# EasyEDA Pro project RCKid3.eprj, schematic RCKid (continued)
## Sheets (continued)
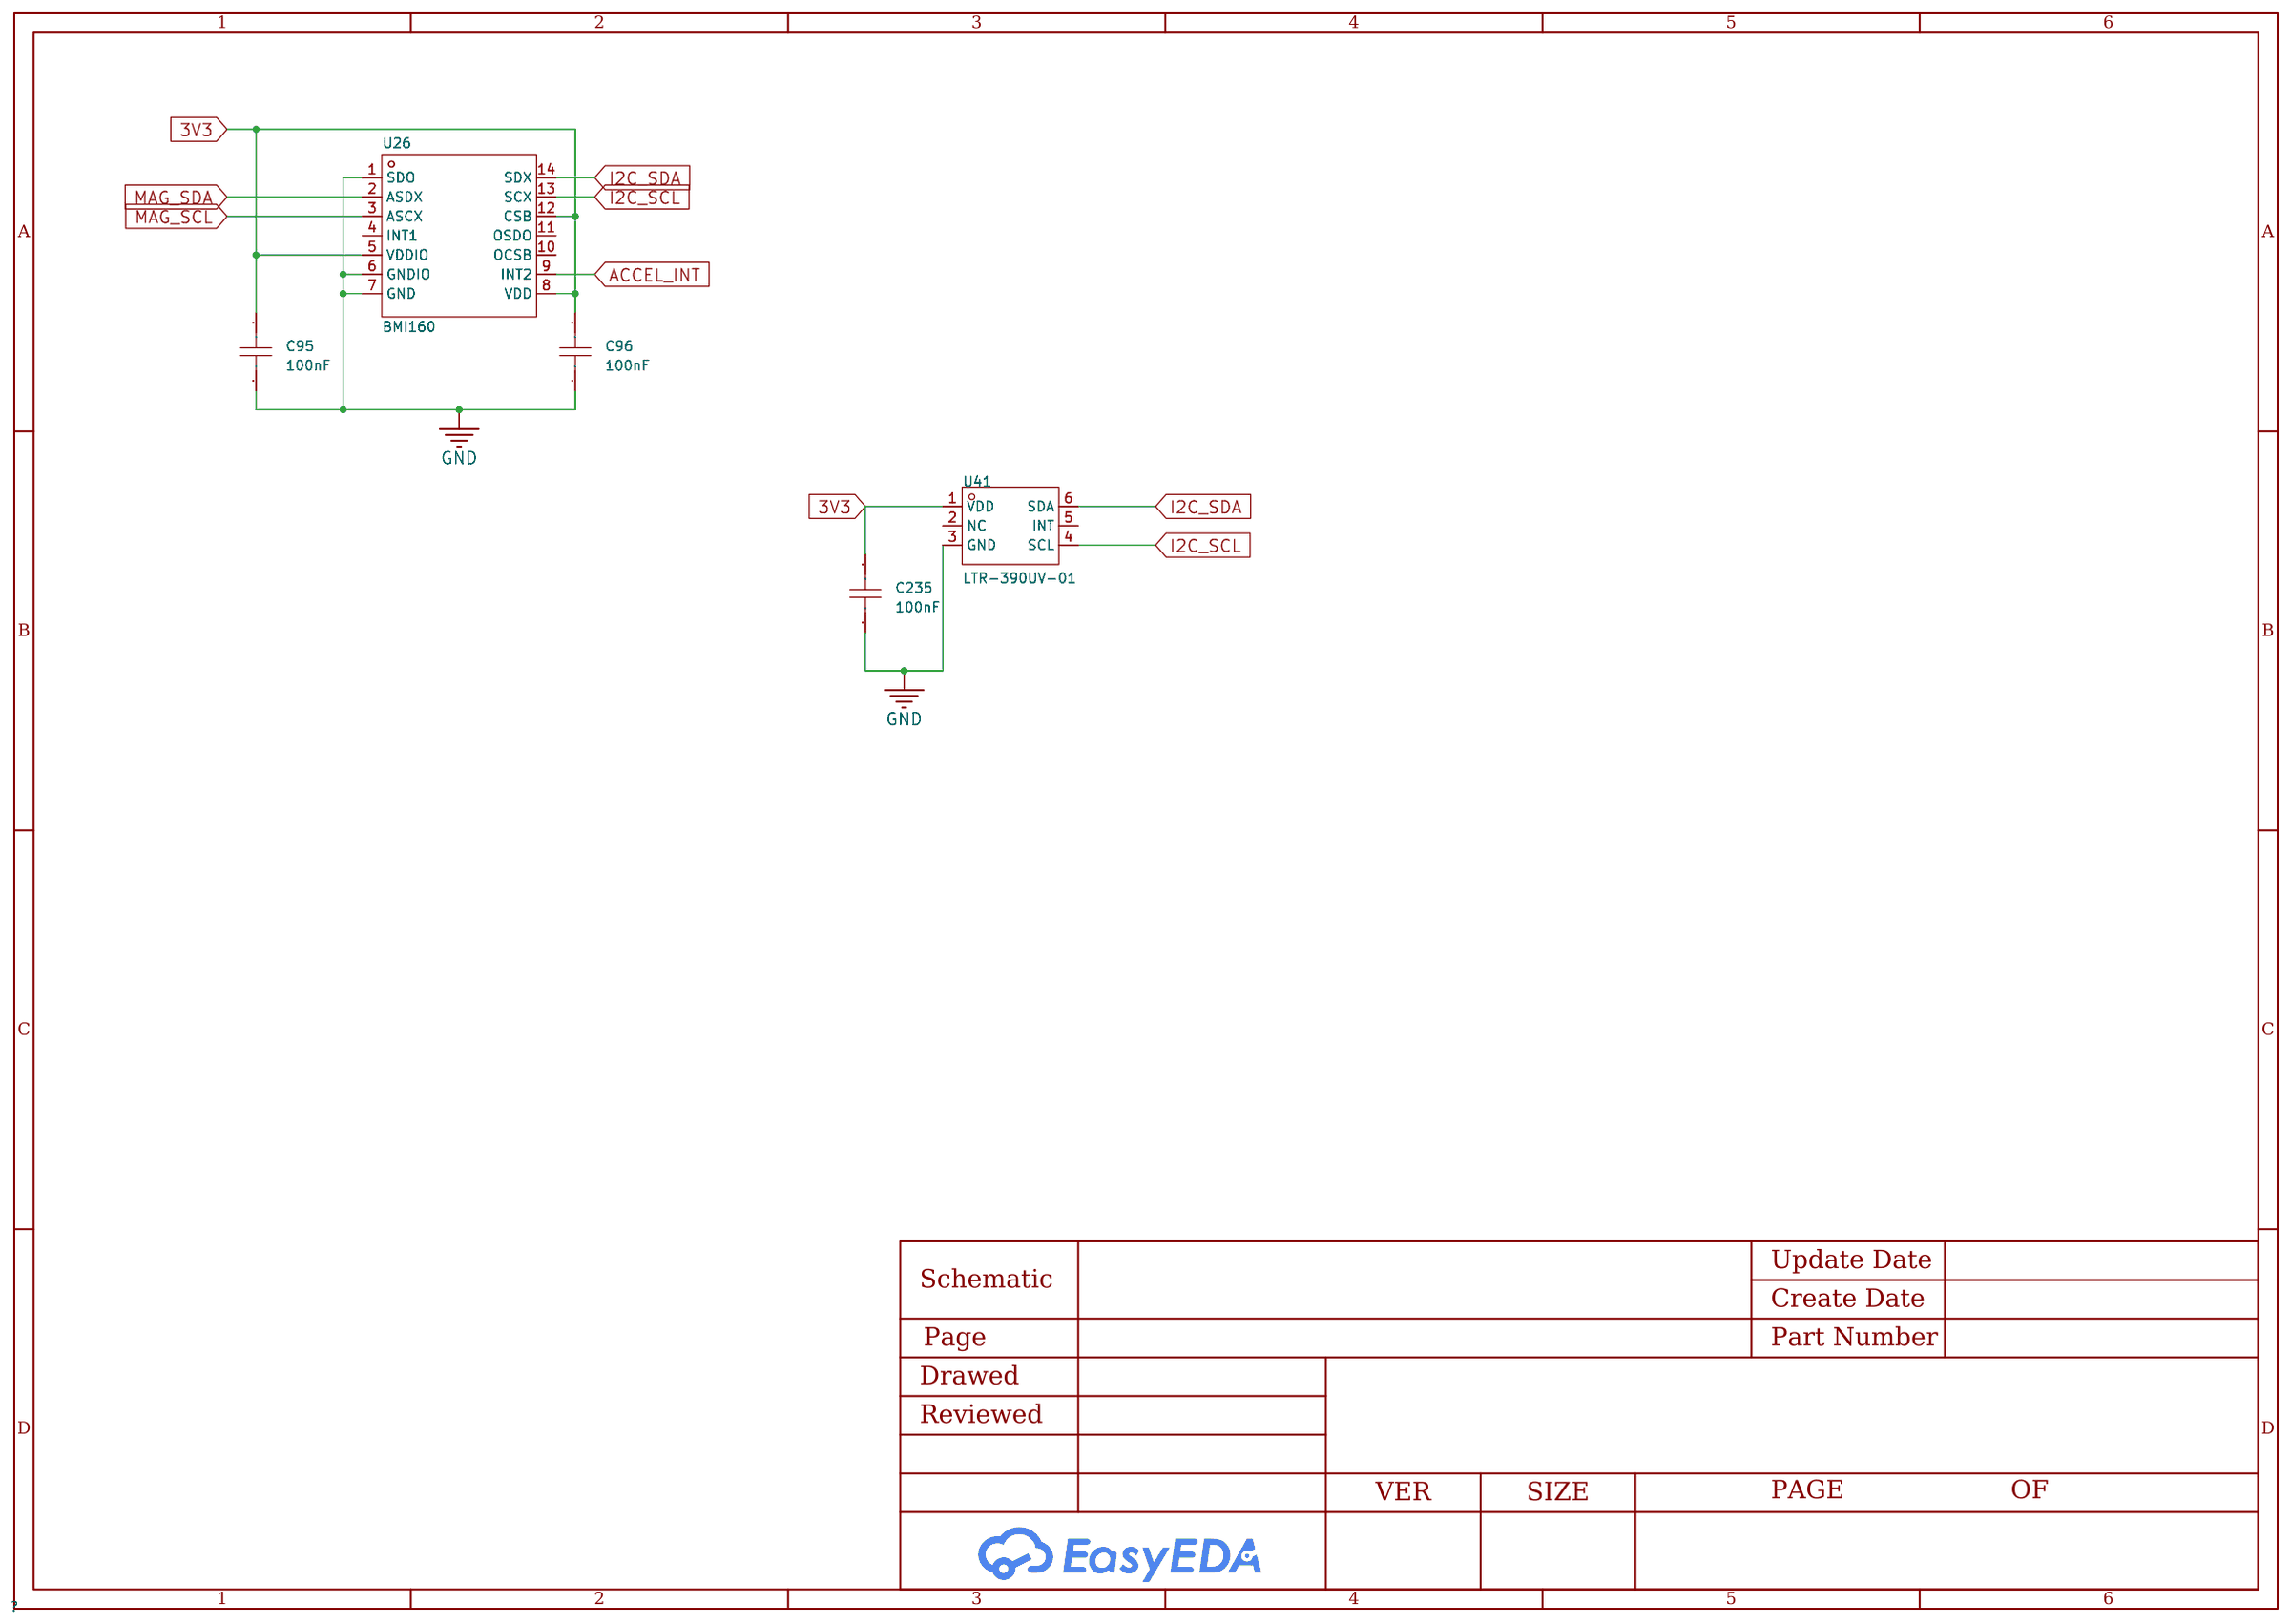
[diagram p7: Sensors]
6 Connectors: Page Name: Connectors; Update Date: 2025-01-20
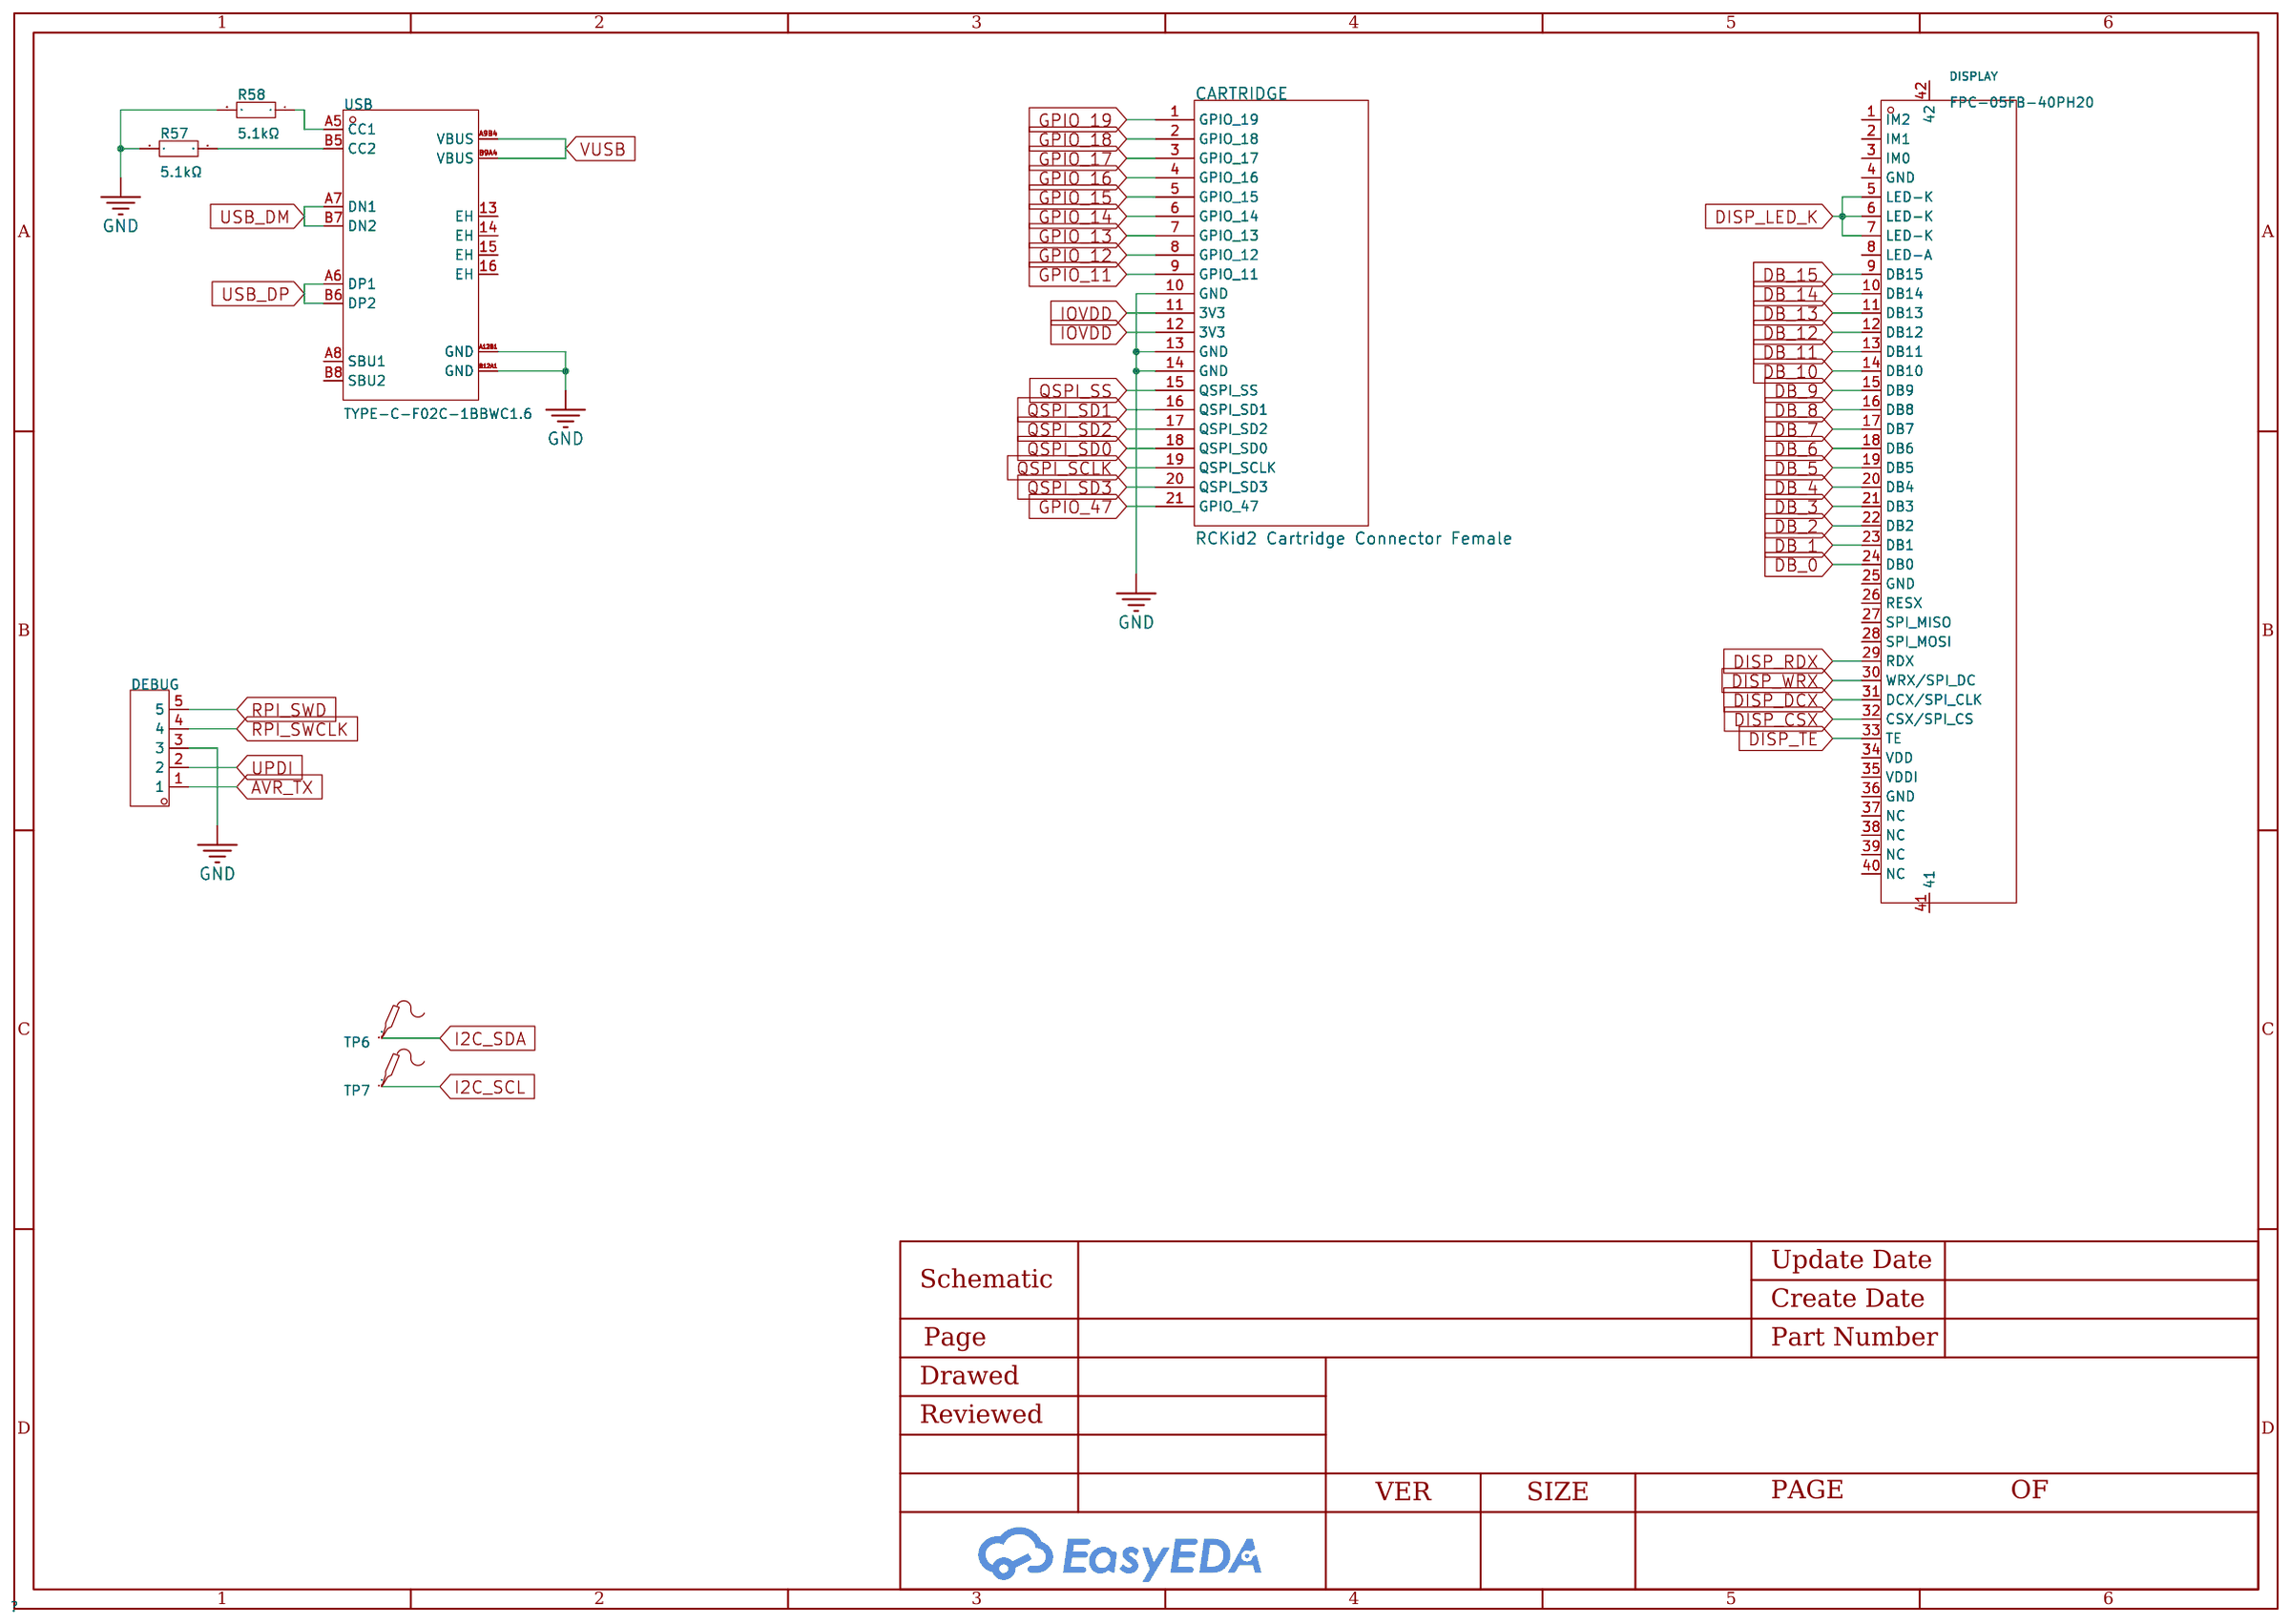
[diagram p8: Connectors]
7 RP2350: Create Date: 2024-12-13; Page Name: RP2350; Update Date: 2025-01-17; Version: V1.0
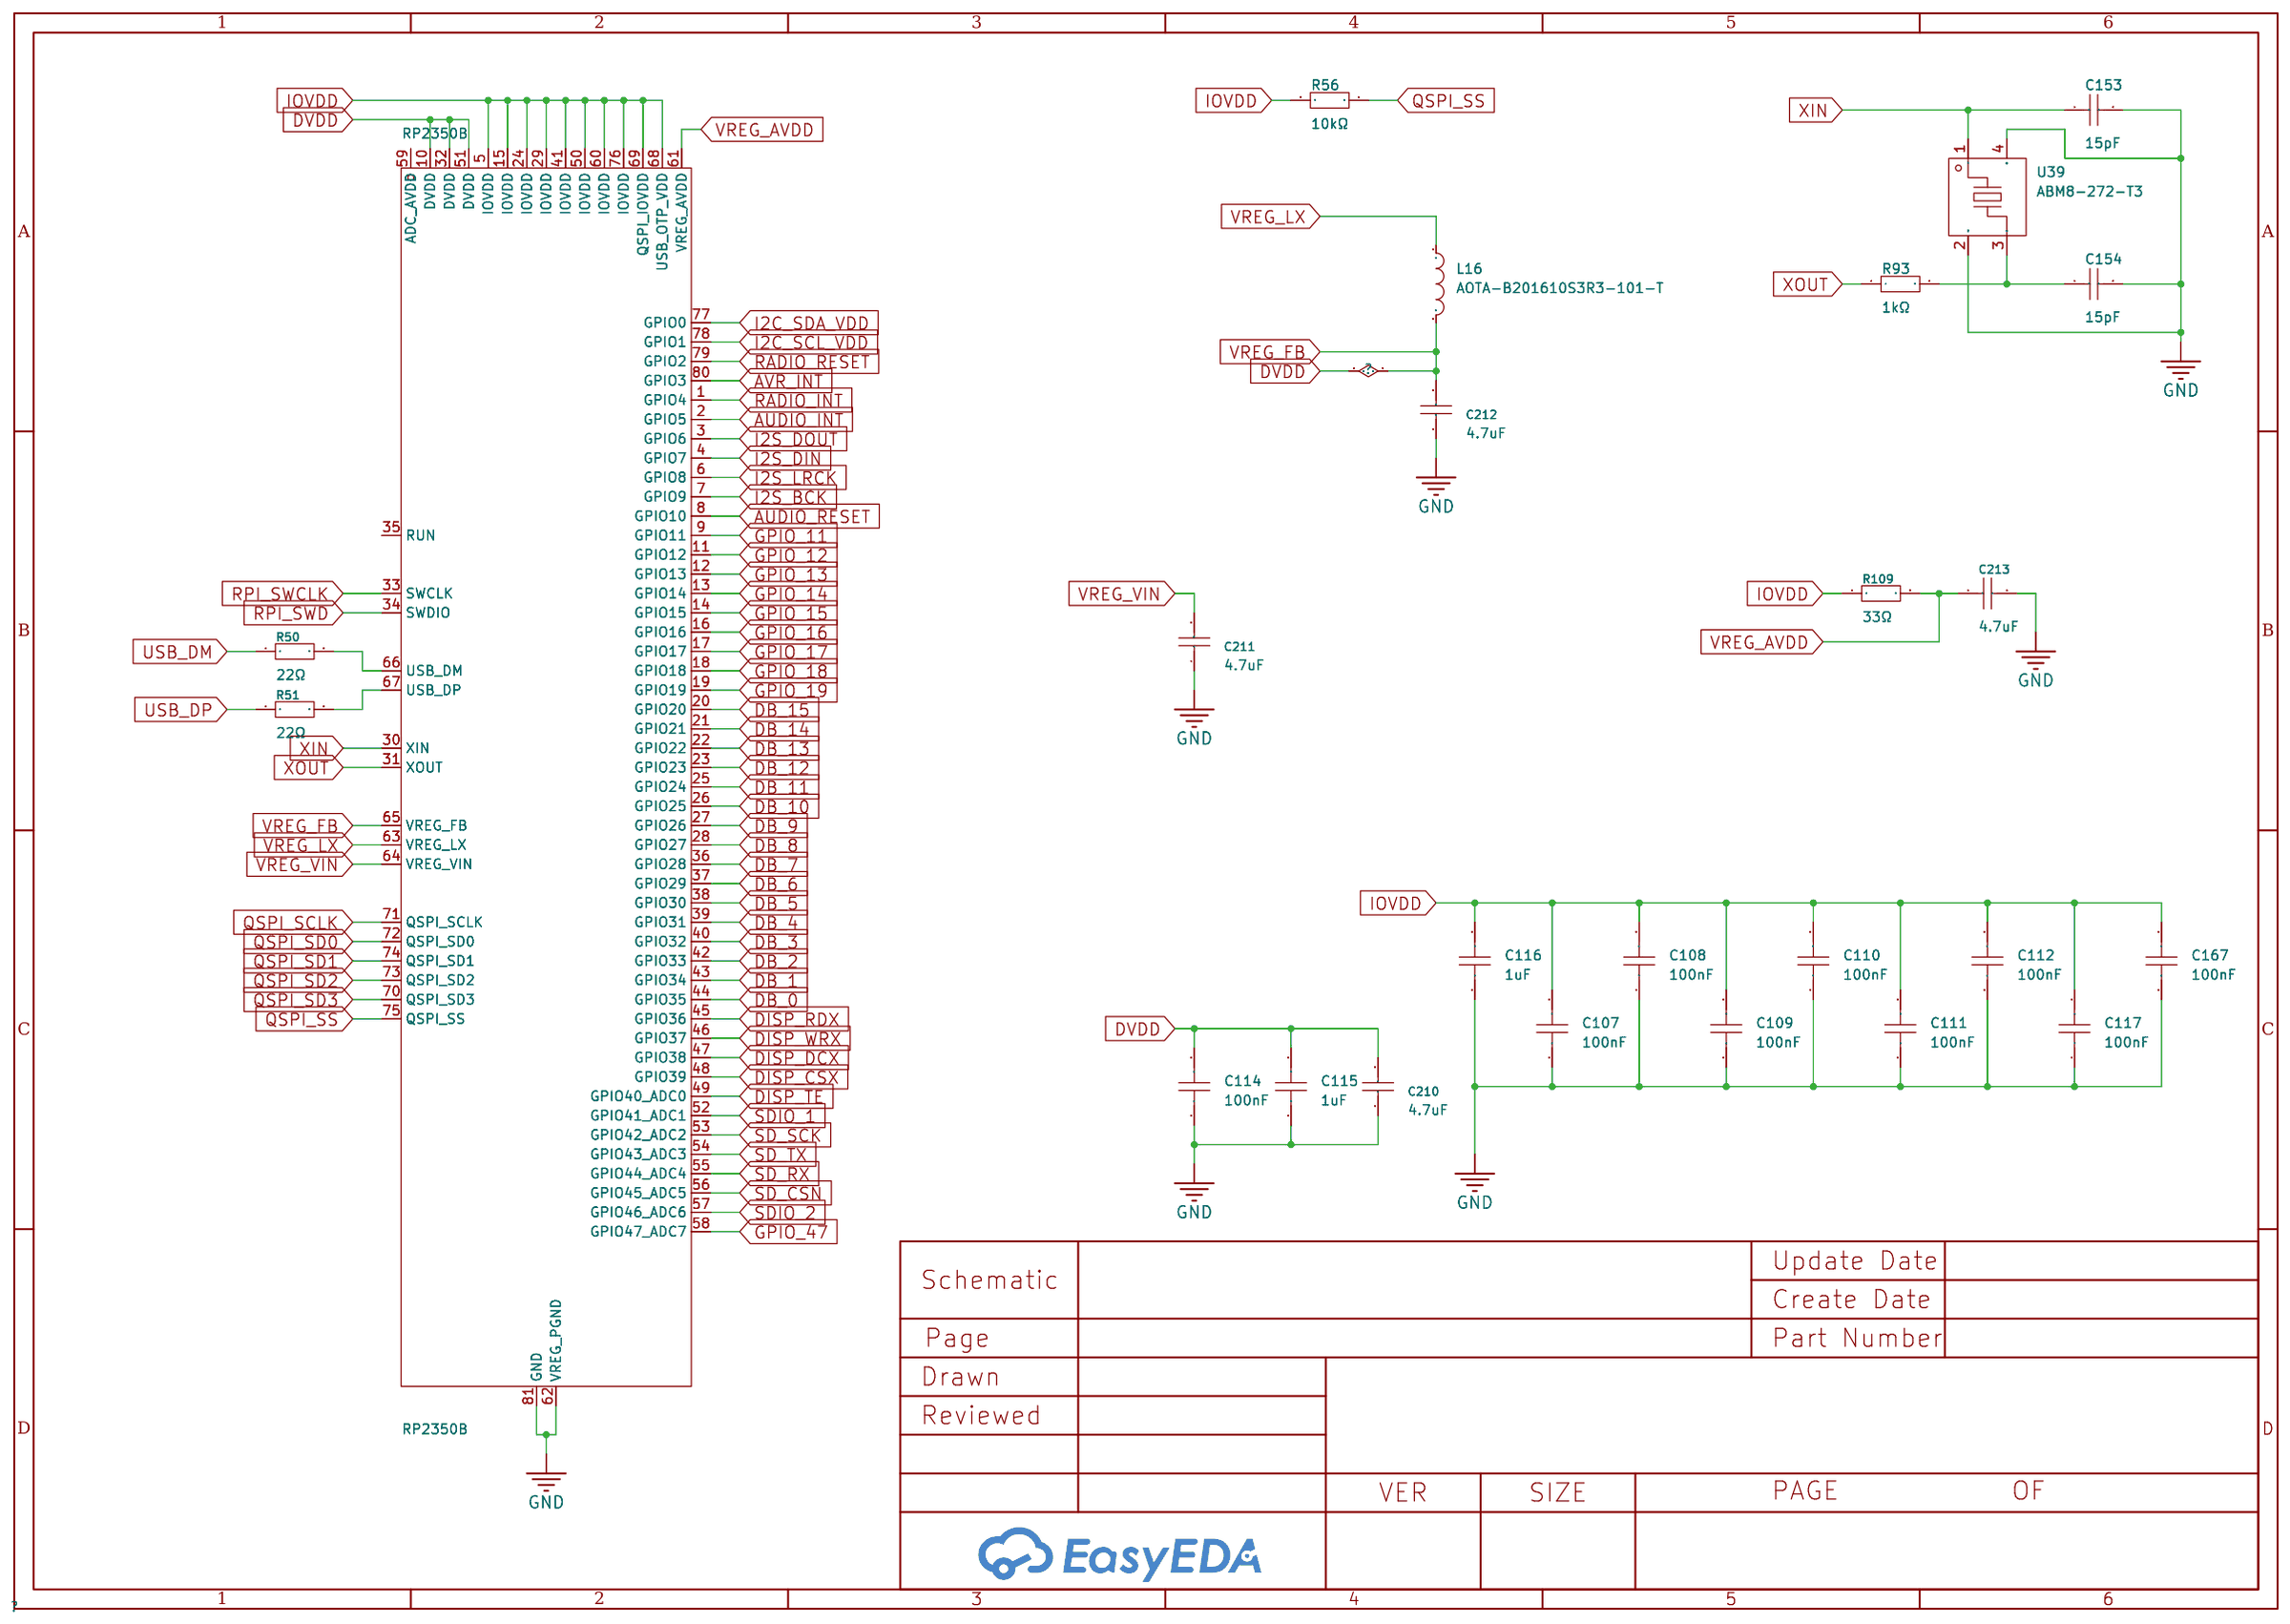
[diagram p9: RP2350]

## Parts
sheet Audio
AMP  TPA2006D1DRBR  [VSON-8_L3.0-W3.0-P0.65-TL-EP]
AUDIO  TLV320AIC3204IRHBR  [QFN-32_L5.0-W5.0-P0.50-TL-EP3.4]
C191  100nF  [C0402]
C192  1uF  [C0402]
C199  220uF  [C1206]
C200  220uF  [C1206]
C201  10uF  [C0402]
C202  10uF  [C0402]
C203  10uF  [C0402]
C204  10uF  [C0402]
C205  100nF  [C0402]
C206  100nF  [C0402]
C207  100nF  [C0402]
C208  1uF  [C0402]
C209  1uF  [C0402]
C236  22nF  [C0402]
C237  100nF  [C0402]
C238  120pF  [C0402]
C239  120pF  [C0402]
C240  100nF  [C0402]
C241  100nF  [C0402]
C242  100pF  [C0402]
C244  100nF  [C0402]
FMA  -  [HDR-TH_1P-V-M_XKB_X4611WV-01I-C28D40]
HEADSET  PJ-342D  [AUDIO-SMD_PJ-342D]
L18  270nH  [L0603]
L19  120nH  [L0805]
MIC  B4013AM422-42  [MIC-SMD_BD4.0_B4013AM423-008]
R103  1kΩ  [R0402]
R104  1kΩ  [R0402]
R105  220kΩ  [R0402]
R106  220kΩ  [R0402]
R121  10kΩ  [R0402]
R122  10kΩ  [R0402]
R123  2.7kΩ  [R0402]
RADIO  SI4705-D60-GMR  [QFN-20_L3.0-W3.0-P0.50-TL-EP1.7_SILICON-LABS_SI4X55]
SPEAKER  -  [SMT wire pad (2)]
TP3  -  [TESTPOINT-SMD_BD1.5_P70-5000045R]
TP4  -  [TESTPOINT-SMD_BD1.5_P70-5000045R]
TP5  -  [TESTPOINT-SMD_BD1.5_P70-5000045R]
X2  32.768kHz  [FC-135R_L3.2-W1.5]
sheet Connectors
CARTRIDGE  RCKid2 Cartridge Connector Female  [RCKID2 CARTRIDGE FEMALE]
DEBUG  -  [HDR-TH_5P-P2.54-V-M]
DISPLAY  FPC-05FB-40PH20  [FPC-SMD_40P-P0.50_XUNPU_FPC-05FB-40PH20]
R57  5.1kΩ  [R0402]
R58  5.1kΩ  [R0402]
TP6  -  [TESTPOINT-SMD_BD1.5_P70-5000045R]
TP7  -  [TESTPOINT-SMD_BD1.5_P70-5000045R]
USB  TYPE-C-F02C-1BBWC1.6  [USB-C-SMD_TYPE-C-F02C-1BBWC1.6]
sheet IO
A1  SKRRACE010  [KEY-SMD_4P-L7.5-W7.0-P5.00-TL]
AVR  ATTINY3217-MFR  [WQFN-24_L4.0-W4.0-P0.50-TL-EP2.6]
B1  SKRRACE010  [KEY-SMD_4P-L7.5-W7.0-P5.00-TL]
B2  SKRRACE010  [KEY-SMD_4P-L7.5-W7.0-P5.00-TL]
B3  SKRRACE010  [KEY-SMD_4P-L7.5-W7.0-P5.00-TL]
BOTTOM1  SKRRACE010  [KEY-SMD_4P-L7.5-W7.0-P5.00-TL]
C101  100nF  [C0402]
C102  100nF  [C0402]
C104  100nF  [C0402]
C118  100nF  [C0402]
C143  100nF  [C0402]
C144  100nF  [C0402]
C232  120pF  [C0402]
C233  120pF  [C0402]
D4  1N5819WS  [SOD-323_L1.8-W1.3-LS2.5-RD]
D5  1N5819WS  [SOD-323_L1.8-W1.3-LS2.5-RD]
D6  1N5819WS  [SOD-323_L1.8-W1.3-LS2.5-RD]
D7  1N5819WS  [SOD-323_L1.8-W1.3-LS2.5-RD]
D8  1N5819WS  [SOD-323_L1.8-W1.3-LS2.5-RD]
D9  1N5819WS  [SOD-323_L1.8-W1.3-LS2.5-RD]
D10  1N5819WS  [SOD-323_L1.8-W1.3-LS2.5-RD]
D11  1N5819WS  [SOD-323_L1.8-W1.3-LS2.5-RD]
D12  1N5819WS  [SOD-323_L1.8-W1.3-LS2.5-RD]
D14  1N5819WS  [SOD-323_L1.8-W1.3-LS2.5-RD]
D15  1N5819WS  [SOD-323_L1.8-W1.3-LS2.5-RD]
D17  1N5819WS  [SOD-323_L1.8-W1.3-LS2.5-RD]
HOME1  B3U-3000PM-B  [KEY-SMD_B3U-3000PM-B]
LED7  XL-1615RGBC-WS2812B  [LED-SMD_4P-L1.6-W1.5_XL-1615RGBC-WS2812B]
LED8  XL-1615RGBC-WS2812B  [LED-SMD_4P-L1.6-W1.5_XL-1615RGBC-WS2812B]
LED10  XL-1615RGBC-WS2812B  [LED-SMD_4P-L1.6-W1.5_XL-1615RGBC-WS2812B]
LED11  XL-1615RGBC-WS2812B  [LED-SMD_4P-L1.6-W1.5_XL-1615RGBC-WS2812B]
LED12  XL-1615RGBC-WS2812B  [LED-SMD_4P-L1.6-W1.5_XL-1615RGBC-WS2812B]
LEFT1  SKRRACE010  [KEY-SMD_4P-L7.5-W7.0-P5.00-TL]
Q6  AO3400A  [SOT-23-3_L2.9-W1.6-P1.90-LS2.8-BR]
Q9  AO3400A  [SOT-23-3_L2.9-W1.6-P1.90-LS2.8-BR]
R54  10kΩ  [R0402]
R55  10kΩ  [R0402]
R84  5.11Ω  [R0402]
R87  470Ω  [R0402]
R88  470Ω  [R0402]
R91  1kΩ  [R0402]
R92  1kΩ  [R0402]
RIGHT1  SKRRACE010  [KEY-SMD_4P-L7.5-W7.0-P5.00-TL]
RUMBLER  -  [SMT wire pad (2)]
TOP1  SKRRACE010  [KEY-SMD_4P-L7.5-W7.0-P5.00-TL]
U33  SN74LVC1T45DBVR  [SOT-23-6_L2.9-W1.6-P0.95-LS2.8-BR]
VOL_DOWN  B3U-3000PM-B  [KEY-SMD_B3U-3000PM-B]
VOL_UP  B3U-3000PM-B  [KEY-SMD_B3U-3000PM-B]
X1  32.768kHz  [FC-135R_L3.2-W1.5]
sheet Logic
C132  22uF  [C0603]
C234  100nF  [C0402]
L15  IP4252CZ16-8-TTL,1  [UDFN-16_L3.3-W1.4-P0.40-BL-EP]
microSD  TF-01A  [TF-SMD_TF-01A]
R45  2.2kΩ  [R0402]
R46  2.2kΩ  [R0402]
R76  10kΩ  [R0402]
R119  10kΩ  [R0402]
R120  10kΩ  [R0402]
U40  TS5A23159RSER  [UQFN-10_L2.0-W1.5-P0.50-BL-EP]
sheet Power
3V3  TPS62825DMQT  [VSON-6_L1.5-W1.5-P0.50-TL]
5V  HX4002-MFC  [SOT-23-6_L2.9-W1.6-P0.95-LS2.8-BR]
AAA_PWR  -  [HDR-TH_2P-P2.54-V-M-1]
BATT  -  [HDR-TH_4P-P2.54-V-M]
C81  10uF  [C0603]
C82  10uF  [C0603]
C83  2.2uF  [C0603]
C214  4.7uF  [C0402]
C215  22uF  [C0603]
C216  22uF  [C0603]
C218  1uF  [C0402]
C219  10uF  [C0603]
C220  10uF  [C0603]
C221  10uF  [C0603]
C224  4.7uF  [C0402]
C225  4.7uF  [C0402]
C228  22uF  [C0603]
C229  22uF  [C0603]
C230  120pF  [C0402]
C231  120pF  [C0402]
C243  47nF  [C0603]
D16  BAT60JFILM  [SOD-323_L1.8-W1.3-LS2.5-RD]
L17  2.2uH  [IND-SMD_L3.0-W3.0_IHLP-1212BZ]
PWR  -  [QFN-24_L4.0-W4.0-P0.50-TL-EP2.7]
Q8  AO3401A  [SOT-23_L2.9-W1.3-P1.90-LS2.4-BR]
R48  10kΩ  [R0402]
R52  10kΩ  [R0402]
R110  10kΩ  [R0402]
R111  10kΩ  [R0402]
R112  10kΩ  [R0402]
R113  10kΩ  [R0402]
R115  100kΩ  [R0402]
R116  100kΩ  [R0402]
R117  450kΩ  [R0402]
R118  450kΩ  [R0402]
R124  10kΩ  [R0402]
R125  24kΩ  [R0402]
R126  300kΩ  [R0805]
R127  570k  [R0805]
TP1  -  [TESTPOINT-SMD_BD1.5_P70-5000045R]
TP2  -  [TESTPOINT-SMD_BD1.5_P70-5000045R]
USB1  470nH  [IND-SMD_L2.0-W1.6]
USB2  470nH  [IND-SMD_L2.0-W1.6]
VDD  TPS62825DMQT  [VSON-6_L1.5-W1.5-P0.50-TL]
sheet RP2350
C107  100nF  [C0402]
C108  100nF  [C0402]
C109  100nF  [C0402]
C110  100nF  [C0402]
C111  100nF  [C0402]
C112  100nF  [C0402]
C114  100nF  [C0402]
C115  1uF  [C0402]
C116  1uF  [C0402]
C117  100nF  [C0402]
C153  15pF  [C0402]
C154  15pF  [C0402]
C167  100nF  [C0402]
C210  4.7uF  [C0402]
C211  4.7uF  [C0402]
C212  4.7uF  [C0402]
C213  4.7uF  [C0402]
L16  AOTA-B201610S3R3-101-T  [IND-SMD_L2.0-W1.6_AOTA-B201610S3R3-101-T]
R50  22Ω  [R0402]
R51  22Ω  [R0402]
R56  10kΩ  [R0402]
R93  1kΩ  [R0402]
R109  33Ω  [R0402]
RP2350B  RP2350B  [QFN-80_L10.0-W10.0-P0.40-TL-EP3.4]
U39  ABM8-272-T3  [CRYSTAL-SMD_4P-L3.2-W2.5-BL]
sheet Sensors
C95  100nF  [C0402]
C96  100nF  [C0402]
C235  100nF  [C0402]
U26  BMI160  [LGA-14_L3.0-W2.5-P0.50-BL]
U41  LTR-390UV-01  [SENSOR-SMD_LTR-390UV-01]

## Library data of the parts
AMP = TPA2006D1DRBR: LCSC Part Name: 2.5W单声道D类音频功率放大器; Supplier Part: C524793; Manufacturer: TI(德州仪器); Supplier Footprint: VSON-8-EP(3x3); JLCPCB Part Class: Extended Part; Datasheet: https://www.ti.com/cn/lit/gpn/tpa2006d1; Supplier: LCSC
AUDIO = TLV320AIC3204IRHBR: LCSC Part Name: 超低功耗立体声音频编解码器; Supplier Part: C24109; Manufacturer: TI(德州仪器); Supplier Footprint: QFN-32-EP(5x5); JLCPCB Part Class: Extended Part; Datasheet: https://www.ti.com/cn/lit/gpn/tlv320aic3204; Supplier: LCSC; Type: Codec; Interface: I2C；SPI; Operating Temperature: -40℃~+85℃
C95 C96 C101 C102 C104 C107-C112 C114 C117 C118 C143 C144 C167 C191 C205-C207 C234 C235 C237 C240 C241 C244 = CL05B104KB54PNC: Capacitance: Tolerance:±10% Tolerance:±10% Voltage Rated: Temperature Coefficient:; LCSC Part Name: 100nF ±10% 50V; Supplier Part: C307331; Manufacturer: SAMSUNG(三星); Supplier Footprint: 0402; JLCPCB Part Class: Basic Part; Datasheet: https://atta.szlcsc.com/upload/public/pdf/source/20181009/C307331_222F7C870FD3EA5F46F538B483443886.pdf; Supplier: LCSC; Tolerance: ±10%
C115 C116 C192 C208 C209 C218 = CL05A105KA5NQNC: Capacitance:Tolerance:±10%Tolerance:±10%VoltageRated:TemperatureCoefficient:; LCSC Part Name: 1uF±10%25V; Supplier Part: C52923; Manufacturer: SAMSUNG(三星); Supplier Footprint: 0402; JLCPCB Part Class: BasicPart; Datasheet: https://atta.szlcsc.com/upload/public/pdf/source/20160103/1457707735223.pdf; Supplier: LCSC; Tolerance: ±10%
C199 C200 = GRM31CR60J227ME11L: LCSC Part Name: 220uF ±20% 6.3V; Supplier Part: C412252; Manufacturer: muRata(村田); Supplier Footprint: 1206; JLCPCB Part Class: Extended Part; Datasheet: https://atta.szlcsc.com/upload/public/pdf/source/20190904/C426118_85E81C7C1F21FC87C5FB6D536E0847B4.pdf; Supplier: LCSC; Tolerance: ±20%
C201-C204 = CL05A106MQ5NUNC: Capacitance:Tolerance:±20%Tolerance:±20%VoltageRated:TemperatureCoefficient:; LCSC Part Name: 10uF±20%6.3V; Supplier Part: C15525; Manufacturer: SAMSUNG(三星); Supplier Footprint: 0402; JLCPCB Part Class: BasicPart; Datasheet: https://atta.szlcsc.com/upload/public/pdf/source/20220823/2B02EE04F8F211D38A52DCB16EB6BEBA.pdf; Supplier: LCSC; Tolerance: ±20%
C236 = 0402B223K500NT: LCSC Part Name: 22nF ±10% 50V; Supplier Part: C1532; Manufacturer: FH(风华); Supplier Footprint: 0402; JLCPCB Part Class: Basic Part; Datasheet: https://atta.szlcsc.com/upload/public/pdf/source/20200305/C486355_26A10D38EF8C2A5C37091D0039909270.pdf; Supplier: LCSC; Tolerance: ±10%
C230-C233 C238 C239 = CC0402JRNPO9BN121: LCSC Part Name: 120pF ±5% 50V; Supplier Part: C106996; Manufacturer: YAGEO(国巨); Supplier Footprint: 0402; JLCPCB Part Class: Extended Part; Datasheet: https://atta.szlcsc.com/upload/public/pdf/source/20170914/C128857_1505359892143968080.pdf; Supplier: LCSC; Tolerance: ±5%
C242 = 0402CG101J500NT: LCSC Part Name: 100pF ±5% 50V; Supplier Part: C1546; Manufacturer: FH(风华); Supplier Footprint: 0402; JLCPCB Part Class: Basic Part; Datasheet: https://atta.szlcsc.com/upload/public/pdf/source/20200305/C486355_26A10D38EF8C2A5C37091D0039909270.pdf; Supplier: LCSC; Tolerance: ±5%
FMA = HDR-M_2.54_1x1P: Supplier Footprint: Through
HEADSET = PJ-342D: LCSC Part Name: 3.5mm耳机座; Supplier Part: C2689707; Manufacturer: XKB Connectivity(中国星坤); Supplier Footprint: SMD; JLCPCB Part Class: Extended Part; Datasheet: https://atta.szlcsc.com/upload/public/pdf/source/20211011/5410BBAF7F4CEA04F8E2A1AE1B358EC2.pdf; Supplier: LCSC; Connector Type: 3.5mm耳机座; Current Rating (Max): 500mA; Voltage Rating (Max): 30V; Operating Temperature Range: -20℃~+70℃; Soldering Temperature(Max): 235℃
L18 = MLF1608DR27JT000: LCSC Part Name: 270nH ±5%; Supplier Part: C87519; Manufacturer: TDK; Supplier Footprint: 0603; JLCPCB Part Class: Extended Part; Datasheet: https://atta.szlcsc.com/upload/public/pdf/source/20191023/C440659_C3A2993F9C3C9B25E061479B1BCAA800.pdf; Supplier: LCSC; Tolerance: ±5%; Q @ Freq: 15@25MHz; Frequency - Self Resonant: 260MHz
L19 = MLF2012DR12JT000: LCSC Part Name: 120nH ±5%; Supplier Part: C275379; Manufacturer: TDK; Supplier Footprint: 0805; JLCPCB Part Class: Extended Part; Datasheet: https://atta.szlcsc.com/upload/public/pdf/source/20190108/C360707_9A5133A313C174521C900275925A1073.pdf; Supplier: LCSC; Tolerance: ±5%; Q @ Freq: 20@25MHz; Frequency - Self Resonant: 360MHz